# EasyEDA Pro project ProProject_IMUSensorNodes202312.epro, board 6_6_拼板20240123（不带编号）
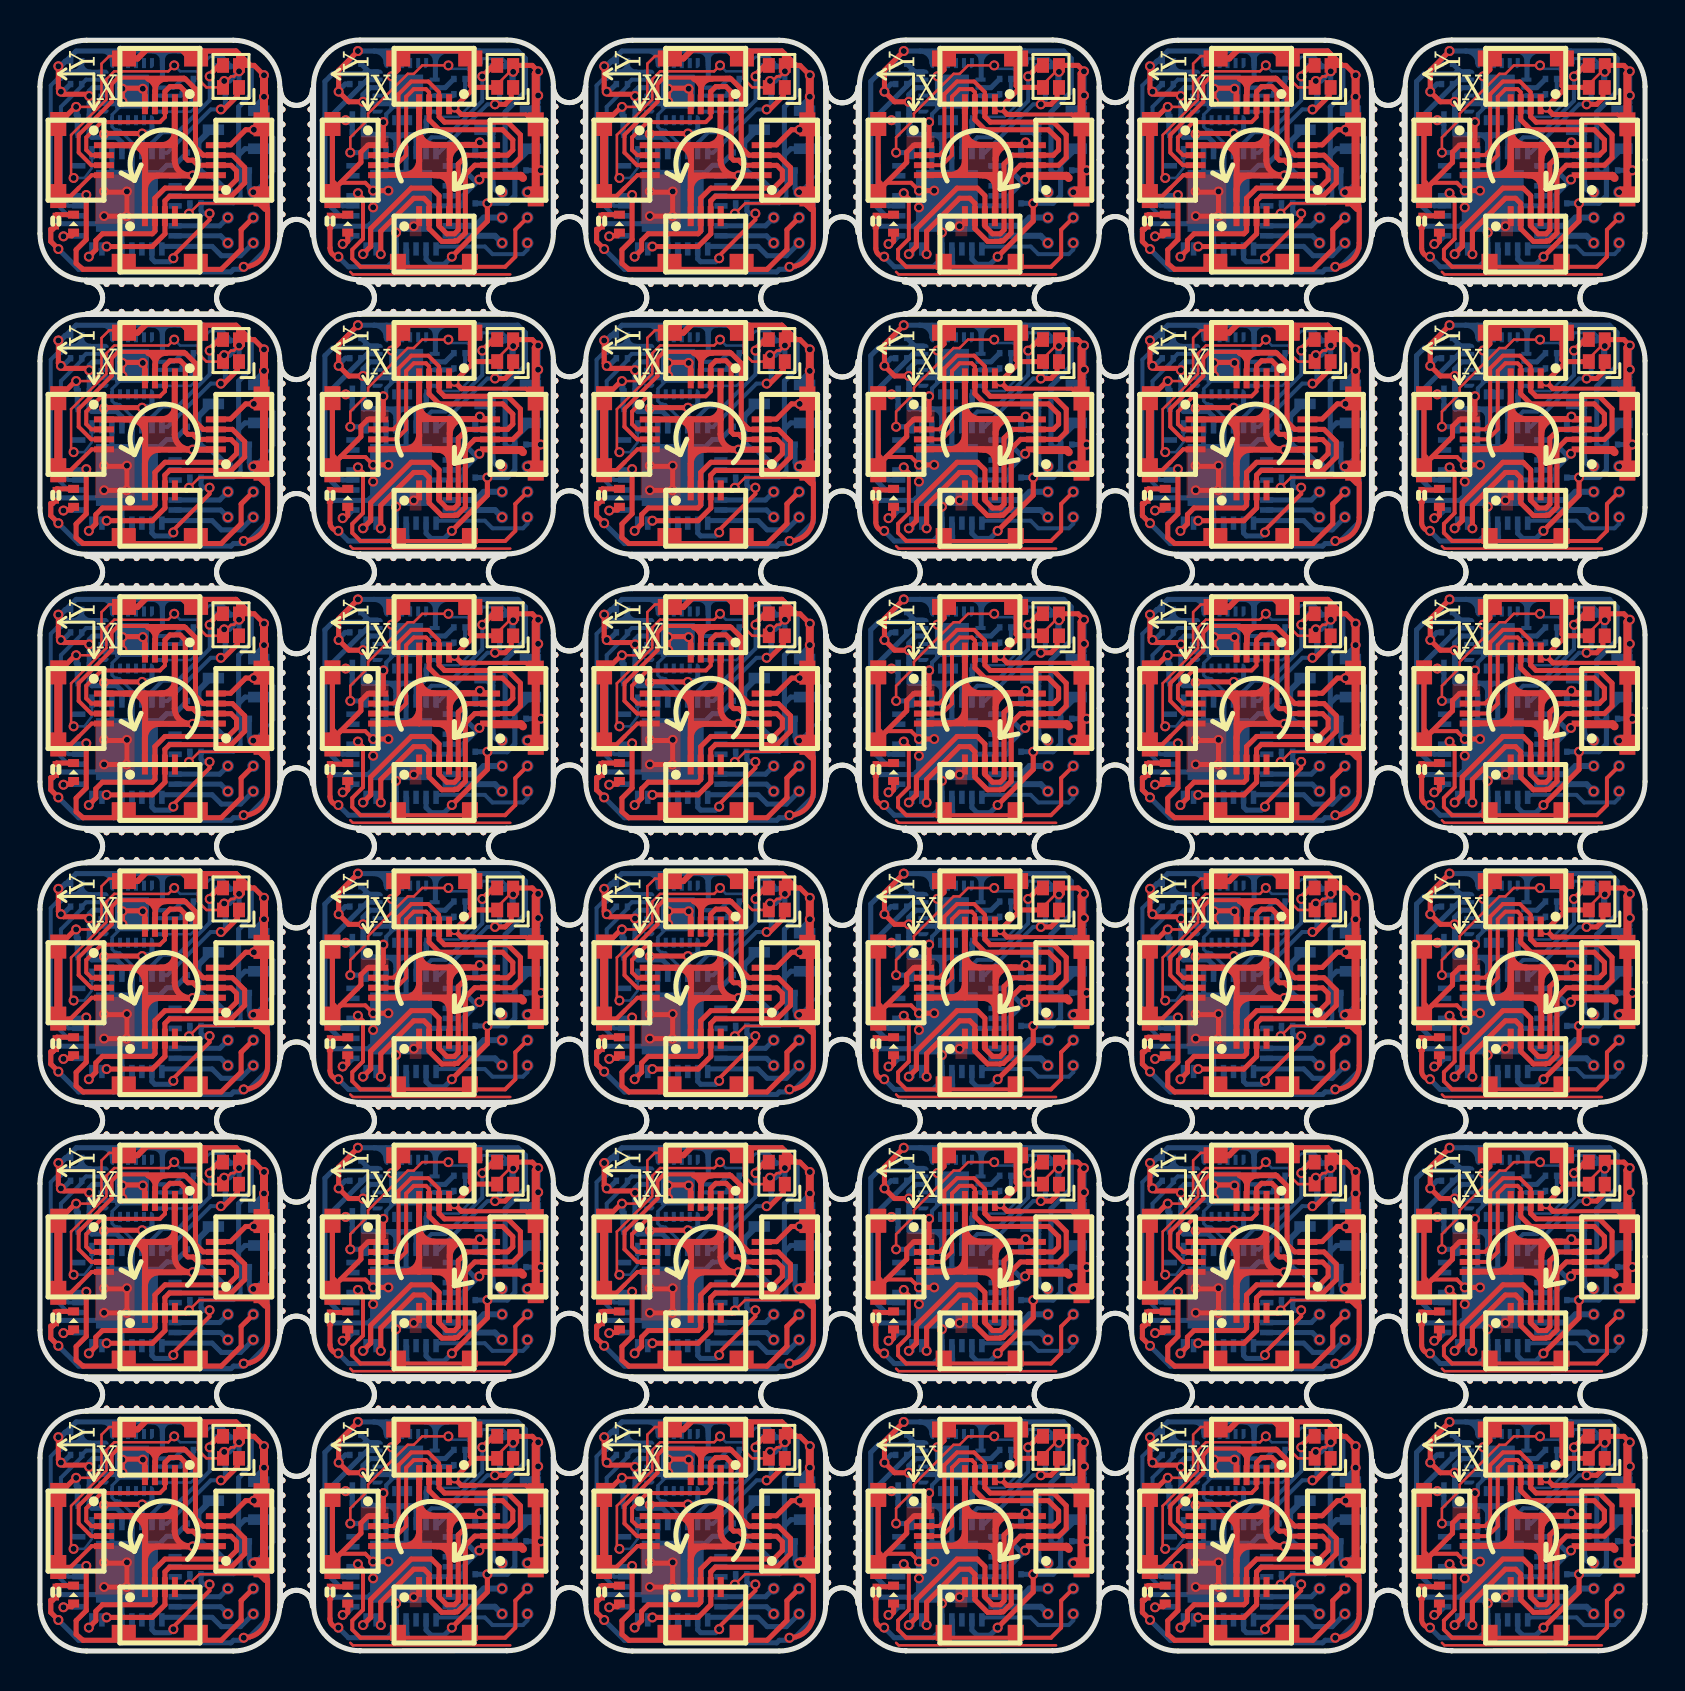
[diagram p6: board, top side]
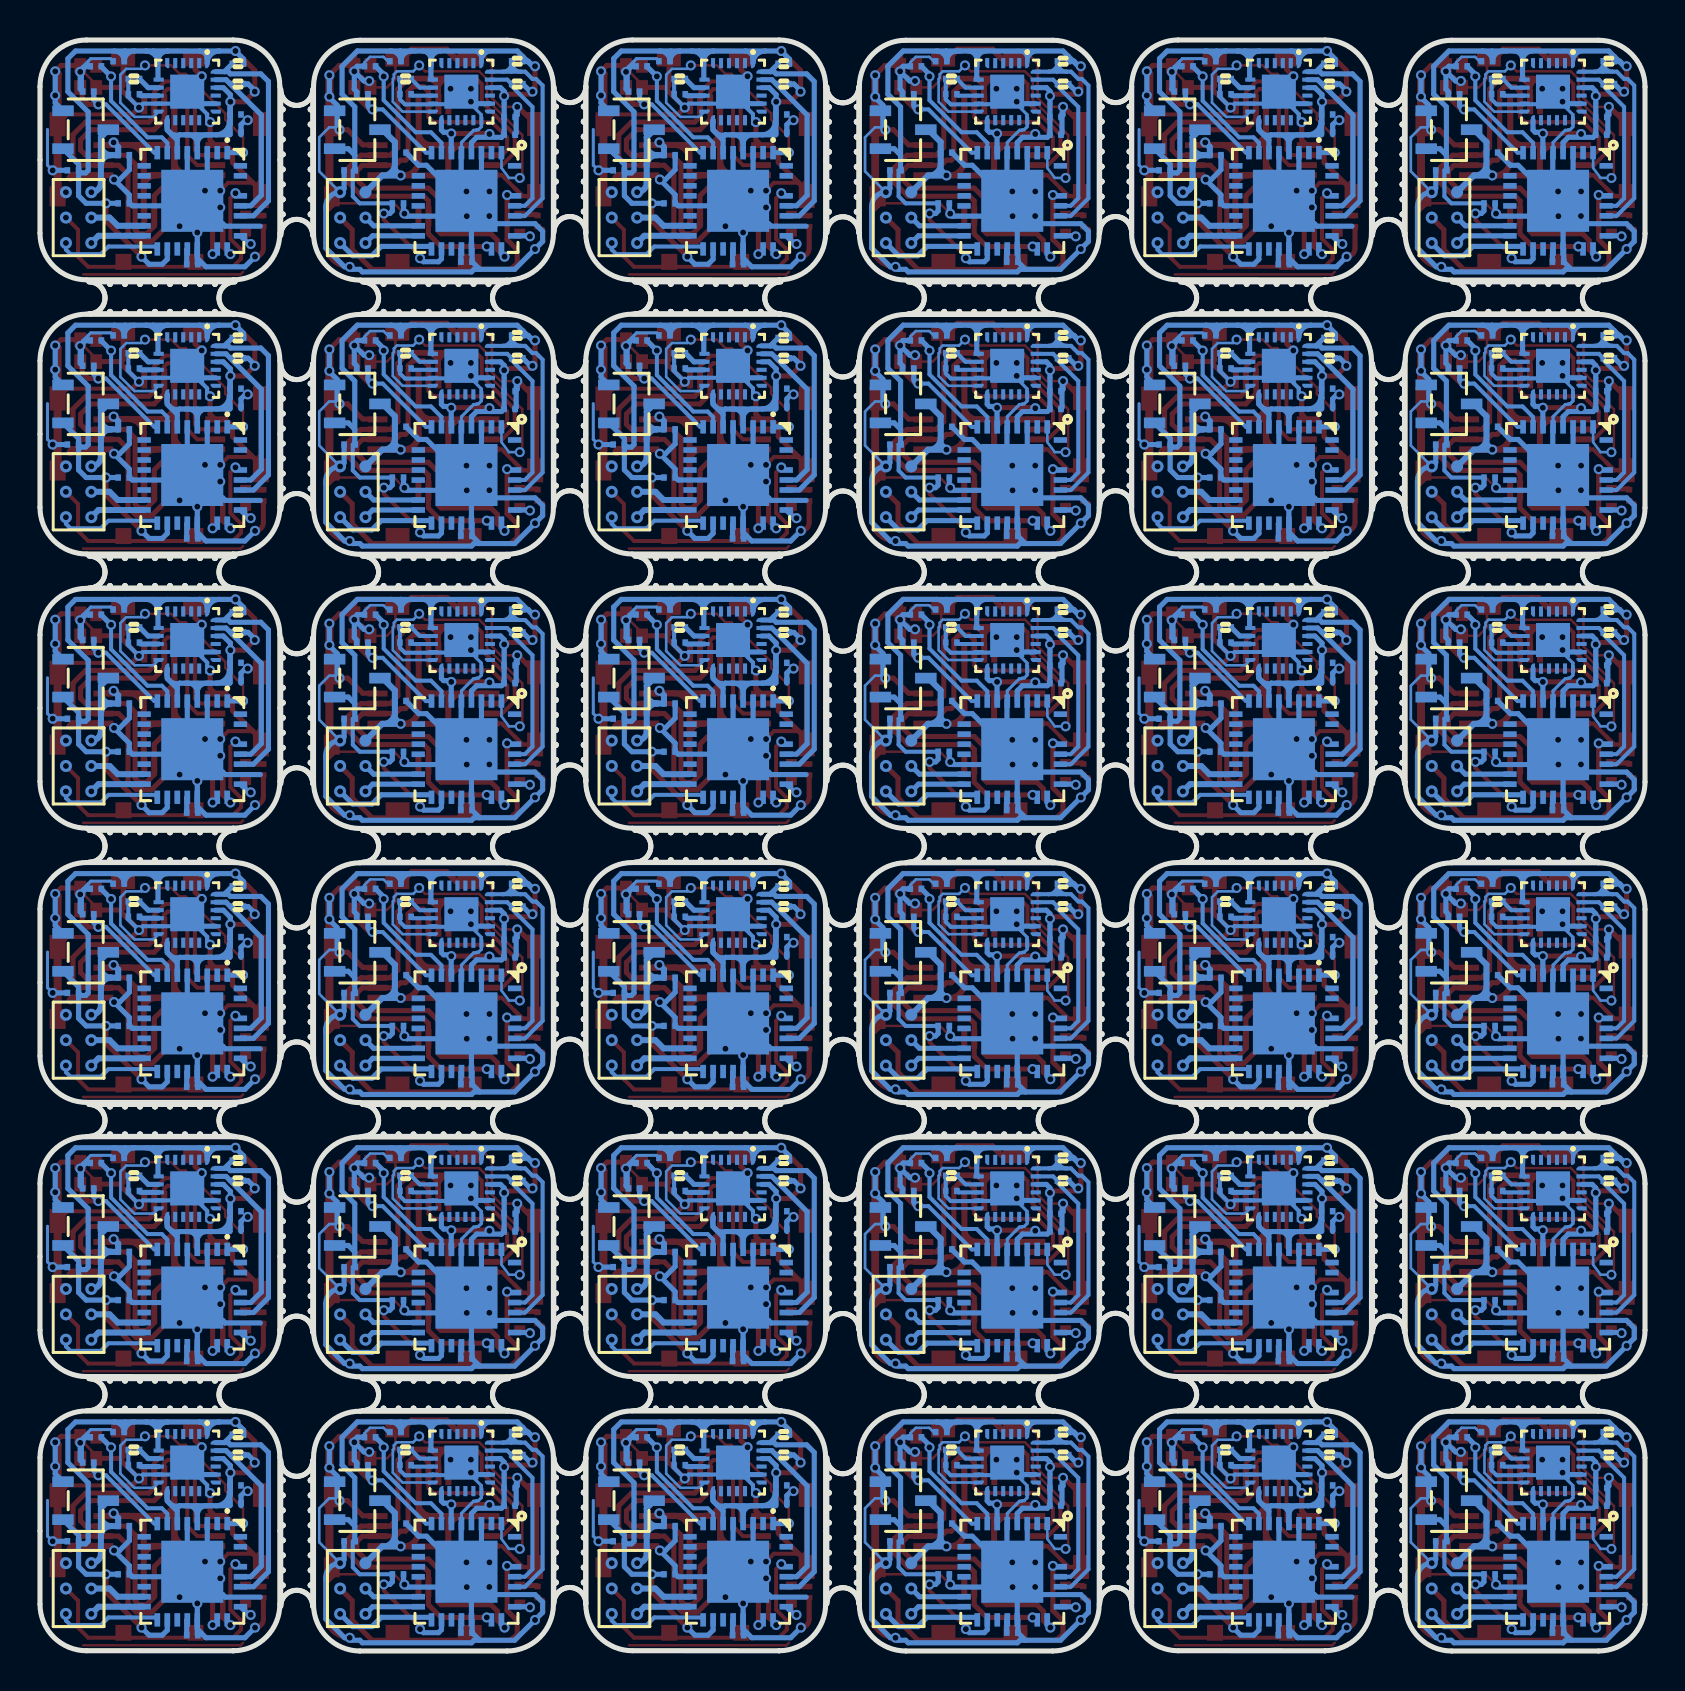
[diagram p7: board, bottom side, seen from below]

Outline 80.29 x 80.59 mm; copper layers: Top Layer, Bottom Layer. Coordinates in mm from the lower left corner of the outline.
Outline path: 0,78.25 0,70.91 arc(0.68,69.26) 2.33,68.58 9.67,68.58 arc(11.32,69.26) 12,70.91 12,78.25 arc(11.32,79.9) 9.67,80.58 2.33,80.58 arc(0.68,79.9) 0,78.25 ; 0,64.53 0,57.19 arc(0.68,55.55) 2.33,54.86 9.67,54.86 arc(11.32,55.55) 12,57.19 12,64.53 arc(11.32,66.18) 9.67,66.86 2.33,66.86 arc(0.68,66.18) 0,64.53 ; 0,50.82 0,43.48 arc(0.68,41.83) 2.33,41.15 9.67,41.15 arc(11.32,41.83) 12,43.48 12,50.82 arc(11.32,52.46) 9.67,53.15 2.33,53.15 arc(0.68,52.46) 0,50.82 ; 0,37.1 0,29.76 arc(0.68,28.11) 2.33,27.43 9.67,27.43 arc(11.32,28.11) 12,29.76 12,37.1 arc(11.32,38.75) 9.67,39.43 2.33,39.43 arc(0.68,38.75) 0,37.1 ; 0,23.38 0,16.05 arc(0.68,14.4) 2.33,13.72 9.67,13.72 arc(11.32,14.4) 12,16.05 12,23.38 arc(11.32,25.03) 9.67,25.71 2.33,25.71 arc(0.68,25.03) 0,23.38 ; 0,9.67 0,2.33 arc(0.68,0.68) 2.33,0 9.67,0 arc(11.32,0.68) 12,2.33 12,9.67 arc(11.32,11.32) 9.67,12 2.33,12 arc(0.68,11.32) 0,9.67 ; 13.69,78.26 arc(14.37,79.91) 16.02,80.59 23.35,80.59 arc(25,79.91) 25.69,78.26 25.69,70.92 arc(25,69.28) 23.35,68.59 16.01,68.59 16.02,68.59 arc(14.37,69.28) 13.69,70.93 13.69,78.26 ; 13.69,64.55 arc(14.37,66.19) 16.02,66.88 23.35,66.88 arc(25,66.19) 25.69,64.54 25.69,57.21 arc(25,55.56) 23.35,54.88 16.01,54.88 16.02,54.88 arc(14.37,55.56) 13.69,57.21 13.69,64.55 ; 13.69,50.83 arc(14.37,52.48) 16.02,53.16 23.35,53.16 arc(25,52.48) 25.69,50.83 25.69,43.49 arc(25,41.84) 23.35,41.16 16.01,41.16 16.02,41.16 arc(14.37,41.84) 13.69,43.49 13.69,50.83 ; 13.69,37.11 arc(14.37,38.76) 16.02,39.44 23.35,39.44 arc(25,38.76) 25.69,37.11 25.69,29.78 arc(25,28.13) 23.35,27.45 16.01,27.44 16.02,27.45 arc(14.37,28.13) 13.69,29.78 13.69,37.11 ; 13.69,23.4 arc(14.37,25.04) 16.02,25.73 23.35,25.73 arc(25,25.04) 25.69,23.39 25.69,16.06 arc(25,14.41) 23.35,13.73 16.01,13.73 16.02,13.73 arc(14.37,14.41) 13.69,16.06 13.69,23.4 ; 13.69,9.68 arc(14.37,11.33) 16.02,12.01 23.35,12.01 arc(25,11.33) 25.69,9.68 25.69,2.34 arc(25,0.7) 23.35,0.01 16.01,0.01 16.02,0.01 arc(14.37,0.7) 13.69,2.35 13.69,9.68 ; 27.31,78.25 27.31,70.91 arc(27.99,69.26) 29.64,68.58 36.97,68.58 arc(38.62,69.26) 39.31,70.91 39.31,78.25 arc(38.62,79.9) 36.97,80.58 29.64,80.58 arc(27.99,79.9) 27.31,78.25 ; 27.31,64.53 27.31,57.19 arc(27.99,55.55) 29.64,54.86 36.97,54.86 arc(38.62,55.55) 39.31,57.19 39.31,64.53 arc(38.62,66.18) 36.97,66.86 29.64,66.86 arc(27.99,66.18) 27.31,64.53 ; 27.31,50.82 27.31,43.48 arc(27.99,41.83) 29.64,41.15 36.97,41.15 arc(38.62,41.83) 39.31,43.48 39.31,50.82 arc(38.62,52.46) 36.97,53.15 29.64,53.15 arc(27.99,52.46) 27.31,50.82 ; 27.31,37.1 27.31,29.76 arc(27.99,28.11) 29.64,27.43 36.97,27.43 arc(38.62,28.11) 39.31,29.76 39.31,37.1 arc(38.62,38.75) 36.97,39.43 29.64,39.43 arc(27.99,38.75) 27.31,37.1 ; 27.31,23.38 27.31,16.05 arc(27.99,14.4) 29.64,13.72 36.97,13.72 arc(38.62,14.4) 39.31,16.05 39.31,23.38 arc(38.62,25.03) 36.97,25.71 29.64,25.71 arc(27.99,25.03) 27.31,23.38 ; 27.31,9.67 27.31,2.33 arc(27.99,0.68) 29.64,0 36.97,0 arc(38.62,0.68) 39.31,2.33 39.31,9.67 arc(38.62,11.32) 36.97,12 29.64,12 arc(27.99,11.32) 27.31,9.67 ; 40.99,78.26 arc(41.67,79.91) 43.32,80.59 50.66,80.59 arc(52.31,79.91) 52.99,78.26 52.99,70.92 arc(52.31,69.28) 50.66,68.59 43.31,68.59 43.32,68.59 arc(41.67,69.28) 40.99,70.93 40.99,78.26 ; 40.99,64.55 arc(41.67,66.19) 43.32,66.88 50.66,66.88 arc(52.31,66.19) 52.99,64.54 52.99,57.21 arc(52.31,55.56) 50.66,54.88 43.31,54.88 43.32,54.88 arc(41.67,55.56) 40.99,57.21 40.99,64.55 ; 40.99,50.83 arc(41.67,52.48) 43.32,53.16 50.66,53.16 arc(52.31,52.48) 52.99,50.83 52.99,43.49 arc(52.31,41.84) 50.66,41.16 43.31,41.16 43.32,41.16 arc(41.67,41.84) 40.99,43.49 40.99,50.83 ; 40.99,37.11 arc(41.67,38.76) 43.32,39.44 50.66,39.44 arc(52.31,38.76) 52.99,37.11 52.99,29.78 arc(52.31,28.13) 50.66,27.45 43.31,27.44 43.32,27.45 arc(41.67,28.13) 40.99,29.78 40.99,37.11 ; 40.99,23.4 arc(41.67,25.04) 43.32,25.73 50.66,25.73 arc(52.31,25.04) 52.99,23.39 52.99,16.06 arc(52.31,14.41) 50.66,13.73 43.31,13.73 43.32,13.73 arc(41.67,14.41) 40.99,16.06 40.99,23.4 ; 40.99,9.68 arc(41.67,11.33) 43.32,12.01 50.66,12.01 arc(52.31,11.33) 52.99,9.68 52.99,2.34 arc(52.31,0.7) 50.66,0.01 43.31,0.01 43.32,0.01 arc(41.67,0.7) 40.99,2.35 40.99,9.68 ; 54.61,78.25 54.61,70.91 arc(55.29,69.26) 56.94,68.58 64.28,68.58 arc(65.93,69.26) 66.61,70.91 66.61,78.25 arc(65.93,79.9) 64.28,80.58 56.94,80.58 arc(55.29,79.9) 54.61,78.25 ; 54.61,64.53 54.61,57.19 arc(55.29,55.55) 56.94,54.86 64.28,54.86 arc(65.93,55.55) 66.61,57.19 66.61,64.53 arc(65.93,66.18) 64.28,66.86 56.94,66.86 arc(55.29,66.18) 54.61,64.53 ; 54.61,50.82 54.61,43.48 arc(55.29,41.83) 56.94,41.15 64.28,41.15 arc(65.93,41.83) 66.61,43.48 66.61,50.82 arc(65.93,52.46) 64.28,53.15 56.94,53.15 arc(55.29,52.46) 54.61,50.82 ; 54.61,37.1 54.61,29.76 arc(55.29,28.11) 56.94,27.43 64.28,27.43 arc(65.93,28.11) 66.61,29.76 66.61,37.1 arc(65.93,38.75) 64.28,39.43 56.94,39.43 arc(55.29,38.75) 54.61,37.1 ; 54.61,23.38 54.61,16.05 arc(55.29,14.4) 56.94,13.72 64.28,13.72 arc(65.93,14.4) 66.61,16.05 66.61,23.38 arc(65.93,25.03) 64.28,25.71 56.94,25.71 arc(55.29,25.03) 54.61,23.38 ; 54.61,9.67 54.61,2.33 arc(55.29,0.68) 56.94,0 64.28,0 arc(65.93,0.68) 66.61,2.33 66.61,9.67 arc(65.93,11.32) 64.28,12 56.94,12 arc(55.29,11.32) 54.61,9.67 ; 68.3,78.26 arc(68.98,79.91) 70.63,80.59 77.96,80.59 arc(79.61,79.91) 80.29,78.26 80.29,70.92 arc(79.61,69.28) 77.96,68.59 70.62,68.59 70.63,68.59 arc(68.98,69.28) 68.3,70.93 68.3,78.26 ; 68.3,64.55 arc(68.98,66.19) 70.63,66.88 77.96,66.88 arc(79.61,66.19) 80.29,64.54 80.29,57.21 arc(79.61,55.56) 77.96,54.88 70.62,54.88 70.63,54.88 arc(68.98,55.56) 68.3,57.21 68.3,64.55 ; 68.3,50.83 arc(68.98,52.48) 70.63,53.16 77.96,53.16 arc(79.61,52.48) 80.29,50.83 80.29,43.49 arc(79.61,41.84) 77.96,41.16 70.62,41.16 70.63,41.16 arc(68.98,41.84) 68.3,43.49 68.3,50.83 ; 68.3,37.11 arc(68.98,38.76) 70.63,39.44 77.96,39.44 arc(79.61,38.76) 80.29,37.11 80.29,29.78 arc(79.61,28.13) 77.96,27.45 70.62,27.44 70.63,27.45 arc(68.98,28.13) 68.3,29.78 68.3,37.11 ; 68.3,23.4 arc(68.98,25.04) 70.63,25.73 77.96,25.73 arc(79.61,25.04) 80.29,23.39 80.29,16.06 arc(79.61,14.41) 77.96,13.73 70.62,13.73 70.63,13.73 arc(68.98,14.41) 68.3,16.06 68.3,23.4 ; 68.3,9.68 arc(68.98,11.33) 70.63,12.01 77.96,12.01 arc(79.61,11.33) 80.29,9.68 80.29,2.34 arc(79.61,0.7) 77.96,0.01 70.62,0.01 70.63,0.01 arc(68.98,0.7) 68.3,2.35 68.3,9.68
Stack: Top Layer 0.035mm / Dielectric1 1.51mm FR4 er 4.5 / Bottom Layer 0.035mm

## Design rules (mm)
template: 自定义配置
spacing copperThickness1oz (default): track to track 0.102, other pairs 0.152 to 0.3
spacing copperThickness2oz: track to track 0.203, other pairs 0.152 to 0.3
track width copperThickness1oz (default): min 0.127, default 0.254, max 2.54
track width copperThickness2oz: min 0.203, default 0.254, max 2.54
differential pair differentialPair (default): width min 0.127, default 0.254, max 2.54; gap min 0.152, default 0.152
via viaSize (default): diameter min 0.5, default 0.61, max 10; hole min 0.3, default 0.305, max 6.299
net GND uses copperRegion1

## Placement (name value [footprint] x y rotation side)
C1  -  [C0201]  21.49 33.68 180 bottom
C1#2  -  [C0201]  34.96 33.81 180 bottom
C1#3  -  [C0201]  48.8 33.68 180 bottom
C1#4  -  [C0201]  62.26 33.81 180 bottom
C1#5  -  [C0201]  76.1 33.68 180 bottom
C1#6  -  [C0201]  76.1 74.83 180 bottom
C1#7  -  [C0201]  7.65 20.09 180 bottom
C1#8  -  [C0201]  21.49 19.97 180 bottom
C1#9  -  [C0201]  34.96 20.09 180 bottom
C1#10  -  [C0201]  48.8 19.97 180 bottom
C1#11  -  [C0201]  62.26 20.09 180 bottom
C1#12  -  [C0201]  76.1 19.97 180 bottom
C1#13  -  [C0201]  7.65 6.38 180 bottom
C1#14  -  [C0201]  21.49 6.25 180 bottom
C1#15  -  [C0201]  34.96 6.38 180 bottom
C1#16  -  [C0201]  48.8 6.25 180 bottom
C1#17  -  [C0201]  62.26 6.38 180 bottom
C1#18  -  [C0201]  76.1 6.25 180 bottom
C1#19  -  [C0201]  7.65 74.96 180 bottom
C1#20  -  [C0201]  62.26 74.96 180 bottom
C1#21  -  [C0201]  21.49 74.83 180 bottom
C1#22  -  [C0201]  34.96 74.96 180 bottom
C1#23  -  [C0201]  48.8 74.83 180 bottom
C1#24  -  [C0201]  7.65 61.24 180 bottom
C1#25  -  [C0201]  21.49 61.12 180 bottom
C1#26  -  [C0201]  34.96 61.24 180 bottom
C1#27  -  [C0201]  48.8 61.12 180 bottom
C1#28  -  [C0201]  62.26 61.24 180 bottom
C1#29  -  [C0201]  76.1 61.12 180 bottom
C1#30  -  [C0201]  7.65 47.53 180 bottom
C1#31  -  [C0201]  21.49 47.4 180 bottom
C1#32  -  [C0201]  34.96 47.53 180 bottom
C1#33  -  [C0201]  48.8 47.4 180 bottom
C1#34  -  [C0201]  62.26 47.53 180 bottom
C1#35  -  [C0201]  76.1 47.4 180 bottom
C1#36  -  [C0201]  7.65 33.81 180 bottom
C2  -  [C0201]  24.03 32.92 0 bottom
C2#2  -  [C0201]  37.5 32.92 0 bottom
C2#3  -  [C0201]  51.34 32.92 0 bottom
C2#4  -  [C0201]  64.8 32.92 0 bottom
C2#5  -  [C0201]  78.64 32.92 0 bottom
C2#6  -  [C0201]  78.64 74.07 0 bottom
C2#7  -  [C0201]  10.19 19.21 0 bottom
C2#8  -  [C0201]  24.03 19.21 0 bottom
C2#9  -  [C0201]  37.5 19.21 0 bottom
C2#10  -  [C0201]  51.34 19.21 0 bottom
C2#11  -  [C0201]  64.8 19.21 0 bottom
C2#12  -  [C0201]  78.64 19.21 0 bottom
C2#13  -  [C0201]  10.19 5.49 0 bottom
C2#14  -  [C0201]  24.03 5.49 0 bottom
C2#15  -  [C0201]  37.5 5.49 0 bottom
C2#16  -  [C0201]  51.34 5.49 0 bottom
C2#17  -  [C0201]  64.8 5.49 0 bottom
C2#18  -  [C0201]  78.64 5.49 0 bottom
C2#19  -  [C0201]  10.19 74.07 0 bottom
C2#20  -  [C0201]  64.8 74.07 0 bottom
C2#21  -  [C0201]  24.03 74.07 0 bottom
C2#22  -  [C0201]  37.5 74.07 0 bottom
C2#23  -  [C0201]  51.34 74.07 0 bottom
C2#24  -  [C0201]  10.19 60.35 0 bottom
C2#25  -  [C0201]  24.03 60.35 0 bottom
C2#26  -  [C0201]  37.5 60.35 0 bottom
C2#27  -  [C0201]  51.34 60.35 0 bottom
C2#28  -  [C0201]  64.8 60.35 0 bottom
C2#29  -  [C0201]  78.64 60.35 0 bottom
C2#30  -  [C0201]  10.19 46.64 0 bottom
C2#31  -  [C0201]  24.03 46.64 0 bottom
C2#32  -  [C0201]  37.5 46.64 0 bottom
C2#33  -  [C0201]  51.34 46.64 0 bottom
C2#34  -  [C0201]  64.8 46.64 0 bottom
C2#35  -  [C0201]  78.64 46.64 0 bottom
C2#36  -  [C0201]  10.19 32.92 0 bottom
C3  -  [C0201]  15.91 35.72 180 bottom
C3#2  -  [C0201]  29.5 35.59 180 bottom
C3#3  -  [C0201]  43.21 35.72 180 bottom
C3#4  -  [C0201]  56.8 35.59 180 bottom
C3#5  -  [C0201]  70.52 35.72 180 bottom
C3#6  -  [C0201]  70.52 76.86 180 bottom
C3#7  -  [C0201]  2.19 21.87 180 bottom
C3#8  -  [C0201]  15.91 22 180 bottom
C3#9  -  [C0201]  29.5 21.87 180 bottom
C3#10  -  [C0201]  43.21 22 180 bottom
C3#11  -  [C0201]  56.8 21.87 180 bottom
C3#12  -  [C0201]  70.52 22 180 bottom
C3#13  -  [C0201]  2.19 8.16 180 bottom
C3#14  -  [C0201]  15.91 8.28 180 bottom
C3#15  -  [C0201]  29.5 8.16 180 bottom
C3#16  -  [C0201]  43.21 8.28 180 bottom
C3#17  -  [C0201]  56.8 8.16 180 bottom
C3#18  -  [C0201]  70.52 8.28 180 bottom
C3#19  -  [C0201]  2.19 76.74 180 bottom
C3#20  -  [C0201]  56.8 76.74 180 bottom
C3#21  -  [C0201]  15.91 76.86 180 bottom
C3#22  -  [C0201]  29.5 76.74 180 bottom
C3#23  -  [C0201]  43.21 76.86 180 bottom
C3#24  -  [C0201]  2.19 63.02 180 bottom
C3#25  -  [C0201]  15.91 63.15 180 bottom
C3#26  -  [C0201]  29.5 63.02 180 bottom
C3#27  -  [C0201]  43.21 63.15 180 bottom
C3#28  -  [C0201]  56.8 63.02 180 bottom
C3#29  -  [C0201]  70.52 63.15 180 bottom
C3#30  -  [C0201]  2.19 49.3 180 bottom
C3#31  -  [C0201]  15.91 49.43 180 bottom
C3#32  -  [C0201]  29.5 49.3 180 bottom
C3#33  -  [C0201]  43.21 49.43 180 bottom
C3#34  -  [C0201]  56.8 49.3 180 bottom
C3#35  -  [C0201]  70.52 49.43 180 bottom
C3#36  -  [C0201]  2.19 35.59 180 bottom
C4  -  [C0201]  76.36 24.67 0 bottom
C4#2  -  [C0201]  7.91 38.38 0 bottom
C4#3  -  [C0201]  21.75 38.38 0 bottom
C4#4  -  [C0201]  35.21 38.38 0 bottom
C4#5  -  [C0201]  49.05 38.38 0 bottom
C4#6  -  [C0201]  62.51 38.38 0 bottom
C4#7  -  [C0201]  76.36 38.38 0 bottom
C4#8  -  [C0201]  76.36 79.53 0 bottom
C4#9  -  [C0201]  7.91 24.67 0 bottom
C4#10  -  [C0201]  21.75 24.67 0 bottom
C4#11  -  [C0201]  35.21 24.67 0 bottom
C4#12  -  [C0201]  62.51 79.53 0 bottom
C4#13  -  [C0201]  49.05 24.67 0 bottom
C4#14  -  [C0201]  62.51 24.67 0 bottom
C4#15  -  [C0201]  7.91 10.95 0 bottom
C4#16  -  [C0201]  21.75 10.95 0 bottom
C4#17  -  [C0201]  35.21 10.95 0 bottom
C4#18  -  [C0201]  49.05 10.95 0 bottom
C4#19  -  [C0201]  62.51 10.95 0 bottom
C4#20  -  [C0201]  76.36 10.95 0 bottom
C4#21  -  [C0201]  7.91 79.53 0 bottom
C4#22  -  [C0201]  21.75 79.53 0 bottom
C4#23  -  [C0201]  35.21 79.53 0 bottom
C4#24  -  [C0201]  49.05 79.53 0 bottom
C4#25  -  [C0201]  7.91 65.81 0 bottom
C4#26  -  [C0201]  21.75 65.81 0 bottom
C4#27  -  [C0201]  35.21 65.81 0 bottom
C4#28  -  [C0201]  49.05 65.81 0 bottom
C4#29  -  [C0201]  62.51 65.81 0 bottom
C4#30  -  [C0201]  76.36 65.81 0 bottom
C4#31  -  [C0201]  7.91 52.1 0 bottom
C4#32  -  [C0201]  21.75 52.1 0 bottom
C4#33  -  [C0201]  35.21 52.1 0 bottom
C4#34  -  [C0201]  49.05 52.1 0 bottom
C4#35  -  [C0201]  62.51 52.1 0 bottom
C4#36  -  [C0201]  76.36 52.1 0 bottom
C5  -  [C0201]  75.6 23.02 180 bottom
C5#2  -  [C0201]  7.4 36.73 180 bottom
C5#3  -  [C0201]  20.99 36.73 180 bottom
C5#4  -  [C0201]  34.7 36.73 180 bottom
C5#5  -  [C0201]  48.29 36.73 180 bottom
C5#6  -  [C0201]  62.01 36.73 180 bottom
C5#7  -  [C0201]  75.6 36.73 180 bottom
C5#8  -  [C0201]  75.6 77.88 180 bottom
C5#9  -  [C0201]  7.4 23.02 180 bottom
C5#10  -  [C0201]  20.99 23.02 180 bottom
C5#11  -  [C0201]  34.7 23.02 180 bottom
C5#12  -  [C0201]  48.29 23.02 180 bottom
C5#13  -  [C0201]  62.01 23.02 180 bottom
C5#14  -  [C0201]  7.4 9.3 180 bottom
C5#15  -  [C0201]  20.99 9.3 180 bottom
C5#16  -  [C0201]  34.7 9.3 180 bottom
C5#17  -  [C0201]  48.29 9.3 180 bottom
C5#18  -  [C0201]  62.01 9.3 180 bottom
C5#19  -  [C0201]  75.6 9.3 180 bottom
C5#20  -  [C0201]  7.4 77.88 180 bottom
C5#21  -  [C0201]  20.99 77.88 180 bottom
C5#22  -  [C0201]  62.01 77.88 180 bottom
C5#23  -  [C0201]  34.7 77.88 180 bottom
C5#24  -  [C0201]  48.29 77.88 180 bottom
C5#25  -  [C0201]  7.4 64.16 180 bottom
C5#26  -  [C0201]  20.99 64.16 180 bottom
C5#27  -  [C0201]  34.7 64.16 180 bottom
C5#28  -  [C0201]  48.29 64.16 180 bottom
C5#29  -  [C0201]  62.01 64.16 180 bottom
C5#30  -  [C0201]  75.6 64.16 180 bottom
C5#31  -  [C0201]  7.4 50.45 180 bottom
C5#32  -  [C0201]  20.99 50.45 180 bottom
C5#33  -  [C0201]  34.7 50.45 180 bottom
C5#34  -  [C0201]  48.29 50.45 180 bottom
C5#35  -  [C0201]  62.01 50.45 180 bottom
C5#36  -  [C0201]  75.6 50.45 180 bottom
C6  -  [C0201]  70.52 21.11 0 bottom
C6#2  -  [C0201]  2.19 34.7 0 bottom
C6#3  -  [C0201]  15.91 34.83 0 bottom
C6#4  -  [C0201]  29.5 34.7 0 bottom
C6#5  -  [C0201]  43.21 34.83 0 bottom
C6#6  -  [C0201]  56.8 34.7 0 bottom
C6#7  -  [C0201]  70.52 34.83 0 bottom
C6#8  -  [C0201]  70.52 75.97 0 bottom
C6#9  -  [C0201]  2.19 20.98 0 bottom
C6#10  -  [C0201]  15.91 21.11 0 bottom
C6#11  -  [C0201]  29.5 20.98 0 bottom
C6#12  -  [C0201]  43.21 21.11 0 bottom
C6#13  -  [C0201]  56.8 20.98 0 bottom
C6#14  -  [C0201]  2.19 7.27 0 bottom
C6#15  -  [C0201]  15.91 7.4 0 bottom
C6#16  -  [C0201]  29.5 7.27 0 bottom
C6#17  -  [C0201]  43.21 7.4 0 bottom
C6#18  -  [C0201]  56.8 7.27 0 bottom
C6#19  -  [C0201]  70.52 7.4 0 bottom
C6#20  -  [C0201]  2.19 75.85 0 bottom
C6#21  -  [C0201]  15.91 75.97 0 bottom
C6#22  -  [C0201]  56.8 75.85 0 bottom
C6#23  -  [C0201]  29.5 75.85 0 bottom
C6#24  -  [C0201]  43.21 75.97 0 bottom
C6#25  -  [C0201]  2.19 62.13 0 bottom
C6#26  -  [C0201]  15.91 62.26 0 bottom
C6#27  -  [C0201]  29.5 62.13 0 bottom
C6#28  -  [C0201]  43.21 62.26 0 bottom
C6#29  -  [C0201]  56.8 62.13 0 bottom
C6#30  -  [C0201]  70.52 62.26 0 bottom
C6#31  -  [C0201]  2.19 48.42 0 bottom
C6#32  -  [C0201]  15.91 48.54 0 bottom
C6#33  -  [C0201]  29.5 48.42 0 bottom
C6#34  -  [C0201]  43.21 48.54 0 bottom
C6#35  -  [C0201]  56.8 48.42 0 bottom
C6#36  -  [C0201]  70.52 48.54 0 bottom
C7  -  [C0201]  18.06 28.22 0 bottom
C7#2  -  [C0201]  31.65 28.35 0 bottom
C7#3  -  [C0201]  45.37 28.22 0 bottom
C7#4  -  [C0201]  58.96 28.35 0 bottom
C7#5  -  [C0201]  72.67 28.22 0 bottom
C7#6  -  [C0201]  72.67 69.37 0 bottom
C7#7  -  [C0201]  4.35 14.63 0 bottom
C7#8  -  [C0201]  18.06 14.51 0 bottom
C7#9  -  [C0201]  31.65 14.63 0 bottom
C7#10  -  [C0201]  45.37 14.51 0 bottom
C7#11  -  [C0201]  58.96 14.63 0 bottom
C7#12  -  [C0201]  72.67 14.51 0 bottom
C7#13  -  [C0201]  4.35 0.92 0 bottom
C7#14  -  [C0201]  18.06 0.79 0 bottom
C7#15  -  [C0201]  31.65 0.92 0 bottom
C7#16  -  [C0201]  45.37 0.79 0 bottom
C7#17  -  [C0201]  58.96 0.92 0 bottom
C7#18  -  [C0201]  72.67 0.79 0 bottom
C7#19  -  [C0201]  4.35 69.5 0 bottom
C7#20  -  [C0201]  58.96 69.5 0 bottom
C7#21  -  [C0201]  18.06 69.37 0 bottom
C7#22  -  [C0201]  31.65 69.5 0 bottom
C7#23  -  [C0201]  45.37 69.37 0 bottom
C7#24  -  [C0201]  4.35 55.78 0 bottom
C7#25  -  [C0201]  18.06 55.66 0 bottom
C7#26  -  [C0201]  31.65 55.78 0 bottom
C7#27  -  [C0201]  45.37 55.66 0 bottom
C7#28  -  [C0201]  58.96 55.78 0 bottom
C7#29  -  [C0201]  72.67 55.66 0 bottom
C7#30  -  [C0201]  4.35 42.07 0 bottom
C7#31  -  [C0201]  18.06 41.94 0 bottom
C7#32  -  [C0201]  31.65 42.07 0 bottom
C7#33  -  [C0201]  45.37 41.94 0 bottom
C7#34  -  [C0201]  58.96 42.07 0 bottom
C7#35  -  [C0201]  72.67 41.94 0 bottom
C7#36  -  [C0201]  4.35 28.35 0 bottom
C8  -  [C0201]  21.49 31.27 180 bottom
C8#2  -  [C0201]  35.08 31.27 180 bottom
C8#3  -  [C0201]  48.8 31.27 180 bottom
C8#4  -  [C0201]  62.39 31.27 180 bottom
C8#5  -  [C0201]  76.1 31.27 180 bottom
C8#6  -  [C0201]  76.1 72.42 180 bottom
C8#7  -  [C0201]  7.78 17.56 180 bottom
C8#8  -  [C0201]  21.49 17.56 180 bottom
C8#9  -  [C0201]  35.08 17.56 180 bottom
C8#10  -  [C0201]  48.8 17.56 180 bottom
C8#11  -  [C0201]  62.39 17.56 180 bottom
C8#12  -  [C0201]  76.1 17.56 180 bottom
C8#13  -  [C0201]  7.78 3.84 180 bottom
C8#14  -  [C0201]  21.49 3.84 180 bottom
C8#15  -  [C0201]  35.08 3.84 180 bottom
C8#16  -  [C0201]  48.8 3.84 180 bottom
C8#17  -  [C0201]  62.39 3.84 180 bottom
C8#18  -  [C0201]  76.1 3.84 180 bottom
C8#19  -  [C0201]  7.78 72.42 180 bottom
C8#20  -  [C0201]  62.39 72.42 180 bottom
C8#21  -  [C0201]  21.49 72.42 180 bottom
C8#22  -  [C0201]  35.08 72.42 180 bottom
C8#23  -  [C0201]  48.8 72.42 180 bottom
C8#24  -  [C0201]  7.78 58.7 180 bottom
C8#25  -  [C0201]  21.49 58.7 180 bottom
C8#26  -  [C0201]  35.08 58.7 180 bottom
C8#27  -  [C0201]  48.8 58.7 180 bottom
C8#28  -  [C0201]  62.39 58.7 180 bottom
C8#29  -  [C0201]  76.1 58.7 180 bottom
C8#30  -  [C0201]  7.78 44.99 180 bottom
C8#31  -  [C0201]  21.49 44.99 180 bottom
C8#32  -  [C0201]  35.08 44.99 180 bottom
C8#33  -  [C0201]  48.8 44.99 180 bottom
C8#34  -  [C0201]  62.39 44.99 180 bottom
C8#35  -  [C0201]  76.1 44.99 180 bottom
C8#36  -  [C0201]  7.78 31.27 180 bottom
C9  -  [C0201]  63.78 24.41 180 bottom
C9#2  -  [C0201]  77.5 24.41 180 bottom
C9#3  -  [C0201]  9.17 38.13 180 bottom
C9#4  -  [C0201]  22.89 38.13 180 bottom
C9#5  -  [C0201]  36.48 38.13 180 bottom
C9#6  -  [C0201]  50.2 38.13 180 bottom
C9#7  -  [C0201]  63.78 38.13 180 bottom
C9#8  -  [C0201]  77.5 38.13 180 bottom
C9#9  -  [C0201]  77.5 79.28 180 bottom
C9#10  -  [C0201]  9.17 24.41 180 bottom
C9#11  -  [C0201]  22.89 24.41 180 bottom
C9#12  -  [C0201]  36.48 24.41 180 bottom
C9#13  -  [C0201]  50.2 24.41 180 bottom
C9#14  -  [C0201]  9.17 10.7 180 bottom
C9#15  -  [C0201]  22.89 10.7 180 bottom
C9#16  -  [C0201]  36.48 10.7 180 bottom
C9#17  -  [C0201]  50.2 10.7 180 bottom
C9#18  -  [C0201]  63.78 10.7 180 bottom
C9#19  -  [C0201]  77.5 10.7 180 bottom
C9#20  -  [C0201]  9.17 79.28 180 bottom
C9#21  -  [C0201]  63.78 79.28 180 bottom
C9#22  -  [C0201]  22.89 79.28 180 bottom
C9#23  -  [C0201]  36.48 79.28 180 bottom
C9#24  -  [C0201]  50.2 79.28 180 bottom
C9#25  -  [C0201]  9.17 65.56 180 bottom
C9#26  -  [C0201]  22.89 65.56 180 bottom
C9#27  -  [C0201]  36.48 65.56 180 bottom
C9#28  -  [C0201]  50.2 65.56 180 bottom
C9#29  -  [C0201]  63.78 65.56 180 bottom
C9#30  -  [C0201]  77.5 65.56 180 bottom
C9#31  -  [C0201]  9.17 51.84 180 bottom
C9#32  -  [C0201]  22.89 51.84 180 bottom
C9#33  -  [C0201]  36.48 51.84 180 bottom
C9#34  -  [C0201]  50.2 51.84 180 bottom
C9#35  -  [C0201]  63.78 51.84 180 bottom
C9#36  -  [C0201]  77.5 51.84 180 bottom
C10  -  [C0201]  64.17 23.02 0 bottom
C10#2  -  [C0201]  77.88 23.14 0 bottom
C10#3  -  [C0201]  9.56 36.73 0 bottom
C10#4  -  [C0201]  23.27 36.86 0 bottom
C10#5  -  [C0201]  36.86 36.73 0 bottom
C10#6  -  [C0201]  50.58 36.86 0 bottom
C10#7  -  [C0201]  64.17 36.73 0 bottom
C10#8  -  [C0201]  77.88 36.86 0 bottom
C10#9  -  [C0201]  77.88 78.01 0 bottom
C10#10  -  [C0201]  9.56 23.02 0 bottom
C10#11  -  [C0201]  23.27 23.14 0 bottom
C10#12  -  [C0201]  36.86 23.02 0 bottom
C10#13  -  [C0201]  50.58 23.14 0 bottom
C10#14  -  [C0201]  9.56 9.3 0 bottom
C10#15  -  [C0201]  23.27 9.43 0 bottom
C10#16  -  [C0201]  36.86 9.3 0 bottom
C10#17  -  [C0201]  50.58 9.43 0 bottom
C10#18  -  [C0201]  64.17 9.3 0 bottom
C10#19  -  [C0201]  77.88 9.43 0 bottom
C10#20  -  [C0201]  9.56 77.88 0 bottom
C10#21  -  [C0201]  64.17 77.88 0 bottom
C10#22  -  [C0201]  23.27 78.01 0 bottom
C10#23  -  [C0201]  36.86 77.88 0 bottom
C10#24  -  [C0201]  50.58 78.01 0 bottom
C10#25  -  [C0201]  9.56 64.16 0 bottom
C10#26  -  [C0201]  23.27 64.29 0 bottom
C10#27  -  [C0201]  36.86 64.16 0 bottom
C10#28  -  [C0201]  50.58 64.29 0 bottom
C10#29  -  [C0201]  64.17 64.16 0 bottom
C10#30  -  [C0201]  77.88 64.29 0 bottom
C10#31  -  [C0201]  9.56 50.45 0 bottom
C10#32  -  [C0201]  23.27 50.58 0 bottom
C10#33  -  [C0201]  36.86 50.45 0 bottom
C10#34  -  [C0201]  50.58 50.58 0 bottom
C10#35  -  [C0201]  64.17 50.45 0 bottom
C10#36  -  [C0201]  77.88 50.58 0 bottom
FPC1  -  [fpc-0.5mm-4p-h1.0]  3.2 60.86 270 top
FPC1#2  -  [fpc-0.5mm-4p-h1.0]  30.5 6 270 top
FPC1#3  -  [fpc-0.5mm-4p-h1.0]  71.53 33.43 270 top
FPC1#4  -  [fpc-0.5mm-4p-h1.0]  3.2 74.58 270 top
FPC1#5  -  [fpc-0.5mm-4p-h1.0]  3.2 19.71 270 top
FPC1#6  -  [fpc-0.5mm-4p-h1.0]  57.81 60.86 270 top
FPC1#7  -  [fpc-0.5mm-4p-h1.0]  71.53 6 270 top
FPC1#8  -  [fpc-0.5mm-4p-h1.0]  57.81 74.58 270 top
FPC1#9  -  [fpc-0.5mm-4p-h1.0]  44.22 19.71 270 top
FPC1#10  -  [fpc-0.5mm-4p-h1.0]  16.92 6 270 top
FPC1#11  -  [fpc-0.5mm-4p-h1.0]  44.22 60.86 270 top
FPC1#12  -  [fpc-0.5mm-4p-h1.0]  3.2 33.43 270 top
FPC1#13  -  [fpc-0.5mm-4p-h1.0]  3.2 6 270 top
FPC1#14  -  [fpc-0.5mm-4p-h1.0]  30.5 60.86 270 top
FPC1#15  -  [fpc-0.5mm-4p-h1.0]  71.53 74.58 270 top
FPC1#16  -  [fpc-0.5mm-4p-h1.0]  44.22 47.15 270 top
FPC1#17  -  [fpc-0.5mm-4p-h1.0]  57.81 47.15 270 top
FPC1#18  -  [fpc-0.5mm-4p-h1.0]  30.5 47.15 270 top
FPC1#19  -  [fpc-0.5mm-4p-h1.0]  16.92 19.71 270 top
FPC1#20  -  [fpc-0.5mm-4p-h1.0]  44.22 74.58 270 top
FPC1#21  -  [fpc-0.5mm-4p-h1.0]  30.5 19.71 270 top
FPC1#22  -  [fpc-0.5mm-4p-h1.0]  44.22 6 270 top
FPC1#23  -  [fpc-0.5mm-4p-h1.0]  16.92 60.86 270 top
FPC1#24  -  [fpc-0.5mm-4p-h1.0]  57.81 33.43 270 top
FPC1#25  -  [fpc-0.5mm-4p-h1.0]  71.53 19.71 270 top
FPC1#26  -  [fpc-0.5mm-4p-h1.0]  44.22 33.43 270 top
FPC1#27  -  [fpc-0.5mm-4p-h1.0]  16.92 47.15 270 top
FPC1#28  -  [fpc-0.5mm-4p-h1.0]  57.81 6 270 top
FPC1#29  -  [fpc-0.5mm-4p-h1.0]  71.53 47.15 270 top
FPC1#30  -  [fpc-0.5mm-4p-h1.0]  71.53 60.86 270 top
FPC1#31  -  [fpc-0.5mm-4p-h1.0]  30.5 74.58 270 top
FPC1#32  -  [fpc-0.5mm-4p-h1.0]  3.2 47.15 270 top
FPC1#33  -  [fpc-0.5mm-4p-h1.0]  16.92 33.43 270 top
FPC1#34  -  [fpc-0.5mm-4p-h1.0]  57.81 19.71 270 top
FPC1#35  -  [fpc-0.5mm-4p-h1.0]  16.92 74.58 270 top
FPC1#36  -  [fpc-0.5mm-4p-h1.0]  30.5 33.43 270 top
FPC2  -  [fpc-0.5mm-4p-h1.0]  74.33 49.95 180 top
FPC2#2  -  [fpc-0.5mm-4p-h1.0]  47.02 77.38 180 top
FPC2#3  -  [fpc-0.5mm-4p-h1.0]  74.33 77.38 180 top
FPC2#4  -  [fpc-0.5mm-4p-h1.0]  6 8.8 180 top
FPC2#5  -  [fpc-0.5mm-4p-h1.0]  19.72 22.51 180 top
FPC2#6  -  [fpc-0.5mm-4p-h1.0]  6 22.51 180 top
FPC2#7  -  [fpc-0.5mm-4p-h1.0]  60.61 36.23 180 top
FPC2#8  -  [fpc-0.5mm-4p-h1.0]  6 77.38 180 top
FPC2#9  -  [fpc-0.5mm-4p-h1.0]  33.31 49.95 180 top